# Altium schematic sheet ReconProbe.SchDoc (part 2 of 2)
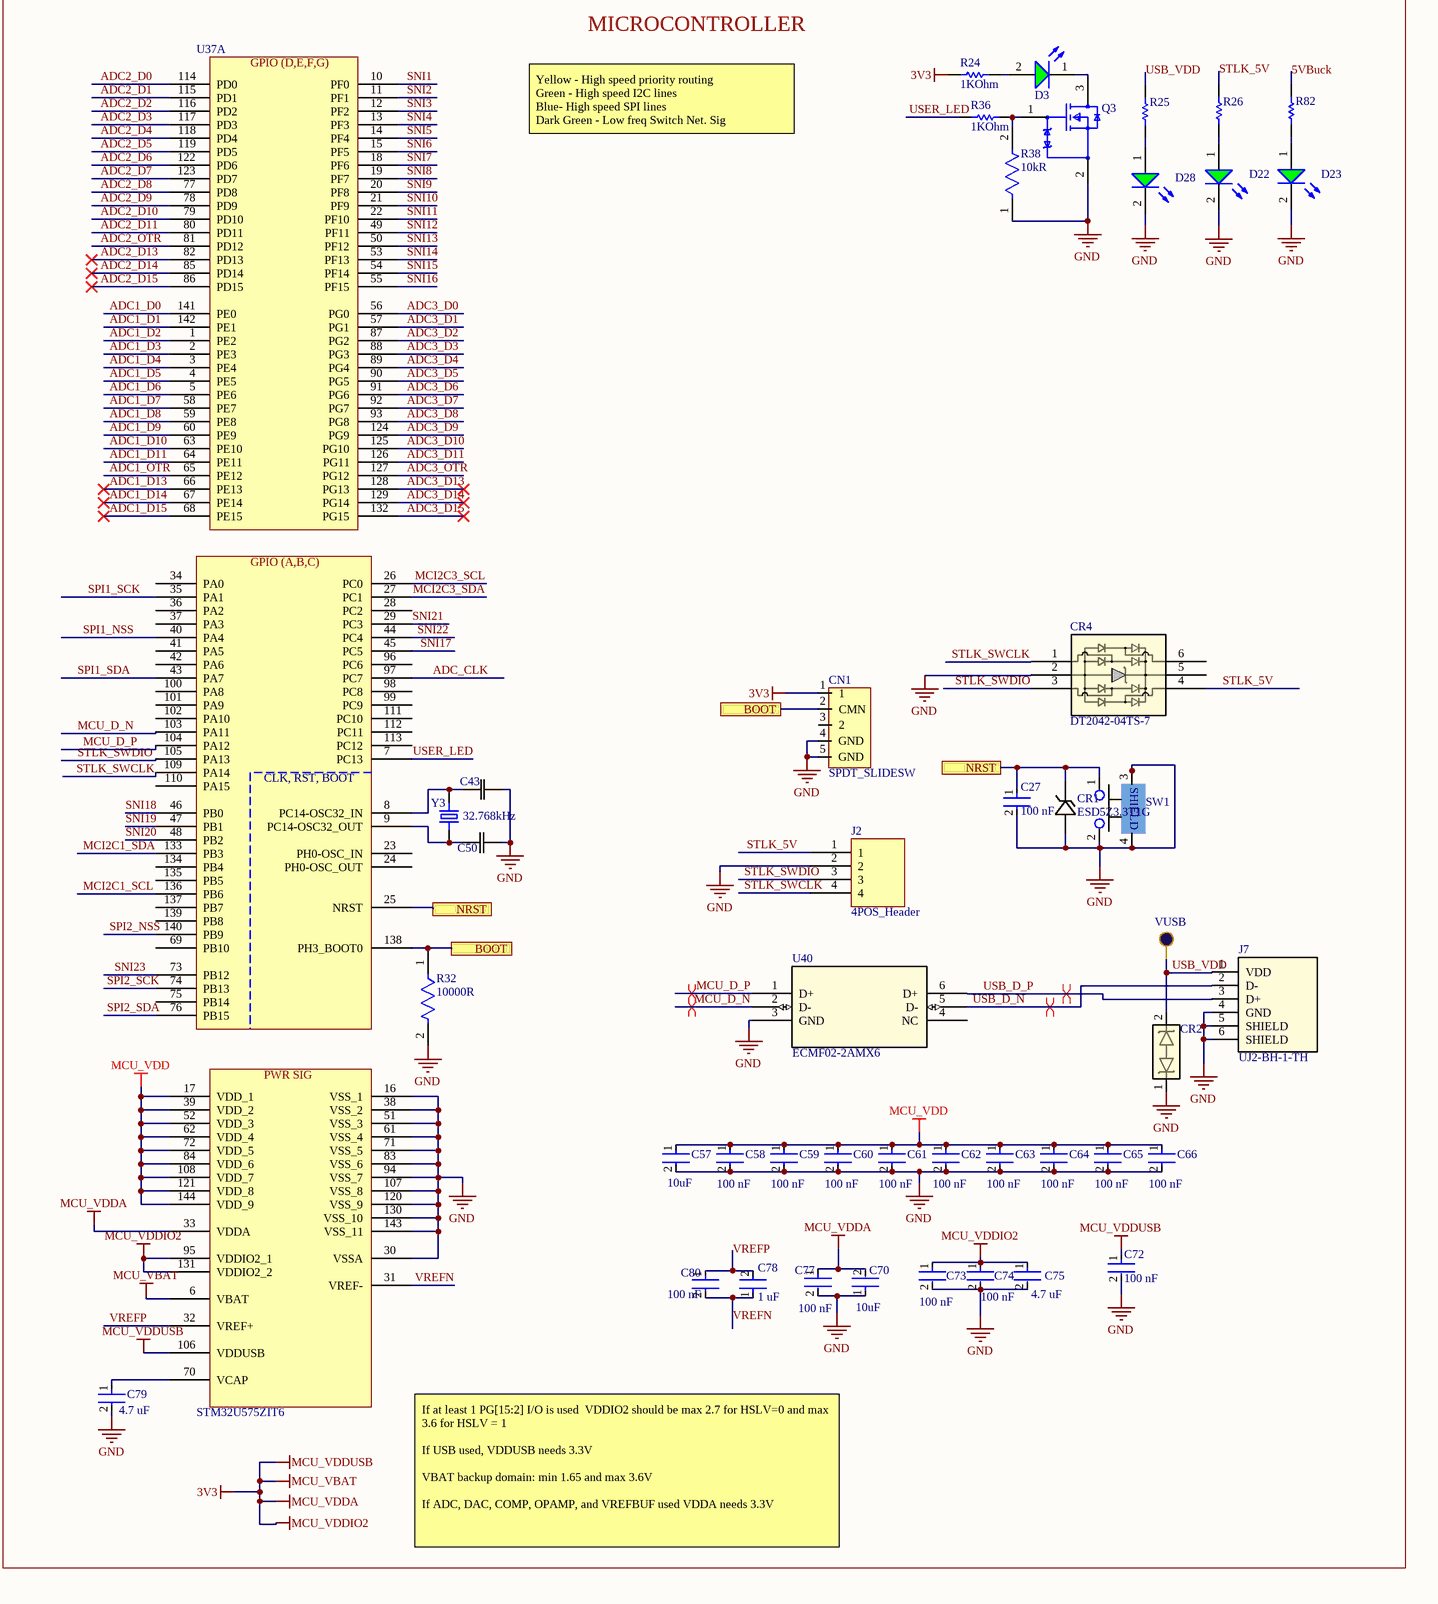
[diagram p6: ReconProbe.SchDoc, bottom right]

## Library data of the parts
0V5 3V0 3V3 VUSB = TestPoint_1.10mm
AD1 AD2 = CMP-0293-00077-1: Low Power, 12.65 mW, 2.3 V to 5.5 V, Programmable Waveform Generator, 10-Bit, Serial, RM-10, 50 Tube, Pb-Free; Resolution (Bits): 10bit; Compliance Range (V): 650mV; FS Iout (mA nom): 3mA; REFCLK Multiplier: No; Master fclk: 25MHz; I Supply total (max): 5.5mA; Tuning Word Width (bits): 28bit; Code_JEDEC: MO-187-BA; DatasheetVersion: Rev. D; PackageVersion: 5/8/2005; ComponentLink1URL: www.analog.com; ComponentLink3Description: Package Specification; PackageDescription: 10-Lead Mini Small Outline Package [MSOP]; I/O Interface: Serial; ComponentLink2Description: Datasheet; ComponentLink1Description: Manufacturer URL; PackageReference: RM-10; ComponentLink2URL: http://www.analog.com/static/imported-files/data_sheets/AD9833.pdf; ComponentLink3URL: http://www.analog.com/static/imported-files/packages/PKG_PDF/MSOP%28RM%29/RM_10.pdf
C1 C2 C13 C69 C71 C78 C88 C89 C93 C96 C97 C122-C125 C142 C146 C147 = CMP-03422-000001-1: CAP CER 1UF 16V X7R 0805; Manufacturer: Yageo; Material: Ceramic; Tolerance: 0.1; Voltage Rating: 16 V; Category: Cap; ComponentLink2Description: Datasheet; Automotive: No; Temperature Range High: +85°C; RoHS: TRUE; Footprint Url: http://www.yageo.com/exep/pages/download/literatures/UPY-C_GEN_24.pdf; Mouser Description: Multilayer Ceramic Capacitors MLCC - SMD/SMT 1.0uF 16V X7R 10%; Height: 0.95mm; Ipc Land Pattern Name: CAPC200125X85; Temperature: -30°C to +85°C; Lead Free: Yes; Value: 1 uF; Temperature Characteristic: X7R; Package: CC0805-0.85; Temperature Range Low: -30°C; Device Class L1: Passive Components; Device Class L3: Ceramic Capacitors; Octopart: https://octopart.com/cc0805kkx7r7bb105-yageo-8376555; Manufacturer Part Number: CC0805KKX7R7BB105; ComponentLink2URL: http://www.yageo.com/documents/recent/UPY-GPHC_Y5V_6.3V-to-50V_8.pdf; Device Class L2: Capacitors; Digikey Description: CAP CER 1UF 16V X7R 0805
C3 C9 C10 C12 C14 C19-C21 C23 C24 C26 C29 C30 C32 C33 C40 = CMP-2008-02108-2: CAP CER 0.1UF 16V X7R 0402; Manufacturer: Kemet; Value: 100nF; Tolerance: 0.1; Material: Ceramic; Temperature Coefficient: 15%; Voltage Rating: 16 V; Package: C0402-BB; Automotive: No; Ipc Land Pattern Name: CAPC10050X50; Device Class L3: Ceramic Capacitors; Octopart: https://octopart.com/c0402c104k4ractu-kemet-94158; Temperature Characteristic: X7R; Mouser Description: Cap Ceramic 0.1uF 16V X7R 10% SMD 0402 125?C Paper T/R - Tape and Reel (Alt: C0402C104K4RAC TU); ComponentLink2Description: Datasheet; Temperature Range Low: -55°C; RoHS: TRUE; Device Class L1: Passive Components; Manufacturer Part Number: C0402C104K4RACTU; Temperature Range High: +125°C; Device Class L2: Capacitors; ComponentLink2URL: https://content.kemet.com/datasheets/KEM_C1002_X7R_SMD.pdf; Category: Cap; Height: 0.55mm; Temperature: -55°C to +125°C; Lead Free: Yes; Digikey Description: CAP CER 0.1UF 16V X7R 0402
C4 C5 C8 C11 C17 C18 C22 C25 C31 C34 C35 C37 C42 C46 C47 C52 C56 C57 C67 C70 C81 C85 C94 C128 C130 C133 C135 C138 = CMP-03422-001507-1: CAP CER 10UF 10V X5R 0603; Tolerance: 10%; Case/Package: 0603; Length: 0.063inch; Dielectric: X5R; Mount: Surface Mount; Case Code (Metric): 1608; Depth: 0.8mm; Voltage Rating (DC): 10V; Voltage Rating: 10V; Lead Free: Lead Free; Resistor Type: Ceramic; Packaging: Tape and Reel; Max Operating Temperature: 85°C; Termination: SMD/SMT; Min Operating Temperature: -55°C; Weight: 7.1E-05oz; Thickness: 0.035inch; Case Code (Imperial): 0603; Package Quantity: 4000; Halogen Free: Halogen Free; RoHS Compliant: Yes; Width: 0.031inch
  C5: Capacitance: 10uF
C6 C7 C15 C16 = CMP-2008-03773-2: Multi-Layer Ceramic Capacitor 3pF C0G  ±0.05pF 0402 Paper T/R; Voltage Rating: 50V; Case Code (Imperial): 0402; Radiation Hardening: No; Max Operating Temperature: 125°C; Case/Package: 0402; Length: 1mm; Depth: 0.5mm; Min Operating Temperature: -55°C; Mount: Surface Mount; Dielectric: C0G; Thickness: 0.022inch; Width: 0.5mm; Voltage Rating (DC): 50V; Case Code (Metric): 1005; Height: 0.5mm; Packaging: Tape and Reel; Termination: SMD/SMT; Package Quantity: 10000
C27 C28 C55 C58-C66 C68 C72-C74 C76 C77 C80 C95 C98 C118 = CMP-03422-000048-1: CAP CER 0.1UF 16V X7R 0402; Manufacturer: YAGEO; Material: Ceramic; Automotive Grade: NA; Temperature Coefficient: 30ppm/°C; Tolerance: 0.1; Value: 100 nF; Device Class L1: Passive Components; Temperature Range Low: -55°C; Device Class L3: Ceramic Capacitors; Temperature Characteristic: X7R; Ipc Land Pattern Name: CAPC10050X50; Temperature Range High: +125°C; Voltage Rating: 16 V; Temperature: -55°C to +125°C; RoHS: TRUE; Automotive: No; Height: 0.55mm; Device Class L2: Capacitors; Digikey Description: CAP CER 0.1UF 16V X7R 0402; Package: CC0402; Footprint Url: http://www.yageo.com/exep/pages/download/literatures/UPY-C_GEN_24.pdf; ComponentLink2Description: Datasheet; Category: Cap; Lead Free: Yes; Octopart: https://octopart.com/cc0402krx7r7bb104-yageo-42244624; ComponentLink2URL: http://www.yageo.com/documents/recent/UPY-GP_NP0_16V-to-50V_16.pdf; Manufacturer Part Number: CC0402KRX7R7BB104; Mouser Description: 0402 0.1 uF 16 V ±10 % Tolerance X7R SMT Multilayer Ceramic Capacitor
C36 C38 C39 C41 C44 C45 C48 C51 C126 C127 C129 C131 C132 C134 C136 C137 = CMP-2008-02108-2: CAP CER 0.1UF 16V X7R 0402; Manufacturer: Kemet; Value: 0.10 μF; Tolerance: 0.1; Material: Ceramic; Temperature Coefficient: 15%; Voltage Rating: 16 V; Package: C0402-BB; Automotive: No; Ipc Land Pattern Name: CAPC10050X50; Device Class L3: Ceramic Capacitors; Octopart: https://octopart.com/c0402c104k4ractu-kemet-94158; Temperature Characteristic: X7R; Mouser Description: Cap Ceramic 0.1uF 16V X7R 10% SMD 0402 125?C Paper T/R - Tape and Reel (Alt: C0402C104K4RAC TU); ComponentLink2Description: Datasheet; Temperature Range Low: -55°C; RoHS: TRUE; Device Class L1: Passive Components; Manufacturer Part Number: C0402C104K4RACTU; Temperature Range High: +125°C; Device Class L2: Capacitors; ComponentLink2URL: https://content.kemet.com/datasheets/KEM_C1002_X7R_SMD.pdf; Category: Cap; Height: 0.55mm; Temperature: -55°C to +125°C; Lead Free: Yes; Digikey Description: CAP CER 0.1UF 16V X7R 0402
C43 C50 = CC0805CRNPO9BN4R0: No Description Available; Mfr_Name: Yageo
C49 C53 C54 C139 C140 = CMP-2008-04254-2: Chip Multilayer Ceramic Capacitors for General Purpose, 0402, 1000pF, C0G, 30ppm/°C, 5%, 50V; Insulation Resistance: 10GR; Packaging: Tape and Reel; Lead Free: Lead Free; Tolerance: 5%; Temperature Coefficient: 30ppm/°C; Thickness: 0.022inch; Termination: SMD/SMT; Max Operating Temperature: 125°C; Height: 0.5mm; Package Quantity: 1; Radiation Hardening: No; Material: Ceramic; Case Code (Metric): 1005; Number of Pins: 2; Voltage Rating: 50V; Mount: Surface Mount; Voltage: 50V; Case/Package: 0402; Min Operating Temperature: -55°C; Dielectric Material: Ceramic; Width: 0.5mm; Depth: 0.5mm; Case Code (Imperial): 0402; REACH SVHC: No SVHC; Dielectric: C0G; Voltage Rating (DC): 50V; Length: 1mm
C75 C79 = CMP-03422-001236-1: CAP CER 4.7UF 16V X5R 0603; Manufacturer: YAGEO; Temperature Coefficient: 15%; Material: Ceramic; Tolerance: 0.1; Temperature Characteristic: X5R; Footprint Url: http://www.yageo.com/exep/pages/download/literatures/UPY-C_GEN_24.pdf; ComponentLink2URL: http://www.yageo.com/documents/recent/UPY-GPHC_X7R_6.3V-to-50V_18.pdf; ComponentLink2Description: Datasheet; Device Class L3: Ceramic Capacitors; Category: Cap; Voltage Rating: 16 V; Automotive: No; Temperature Range High: +125°C; Value: 4.7 uF; Device Class L1: Passive Components; RoHS: TRUE; Manufacturer Part Number: CC0603KRX5R7BB475; Device Class L2: Capacitors; Voltage: 16 V; Height: 0.9mm; Temperature Range Low: -55°C; Temperature: -55°C to +125°C; Mouser Description: Multilayer Ceramic Capacitors MLCC - SMD/SMT 4.7uF 16V X5R 10%; Octopart: https://octopart.com/cc0603krx5r7bb475-yageo-34978295; Package: CC0603-DA; Lead Free: Yes; Digikey Description: CAP CER 4.7UF 16V X5R 0603
C82 C83 = RHA1C151MCN1GS: No Description Available; Mfr_Name: Nichicon
C84 C99-C117 C119 C141 C143 = CMP-13271-001433-1: CL21 Series 0805 1uF 50V ±10% Tolerance X7R Multilayer Ceramic Chip Capacitor; Case Code (Metric): 2012; Max Operating Temperature: 125°C; Termination: Wraparound; Voltage: 50V; Min Operating Temperature: -55°C; Packaging: Tape and Reel; Contact Plating: Tin; Case/Package: 0805; Depth: 1.25mm; Case Code (Imperial): 0805; Mount: Surface Mount; Material: Ceramic; Tolerance: 10%; Thickness: 0.053inch; Package Quantity: 3000; Voltage Rating: 50V; Width: 0.049inch; Length: 2mm; Dielectric: X7R
C86 = CMP-2006-02467-2: Chip Multilayer Ceramic Capacitors for General Purpose, 0603, 3300pF, C0G, 30ppm/°C, 5%, 50V; Max Operating Temperature: 125°C; Voltage Rating (DC): 50V; Termination: SMD/SMT; Packaging: Tape and Reel; Tolerance: 5%; Lead Free: Lead Free; Width: 0.031inch; Thickness: 0.035inch; REACH SVHC: No SVHC; Dielectric: C0G; Min Operating Temperature: -55°C; Material: Ceramic; Voltage Rating: 50V; Case/Package: 0603; Length: 1.6mm; Voltage: 50V; Case Code (Imperial): 0603; Radiation Hardening: No; Case Code (Metric): 1608; Mount: Surface Mount; Height: 0.8mm; Package Quantity: 4000; Depth: 0.8mm
C87 = CMP-13271-003225-1: CL21 Series 0805 22uF 25V ±20% Tolerance X5R Multilayer Ceramic Chip Capacitor
C90 C92 = CMP-08246-006241-1: Multilayer Ceramic Capacitors 2.2μF ±10% 16V X7R SMD 0805; Radiation Hardening: No; Series: C; REACH SVHC: No SVHC; Max Operating Temperature: 125°C; Case Code (Metric): 2012; Construction: Flat; Lead Free: Lead Free; Number of Pins: 2; Voltage Rating: 16V; Min Operating Temperature: -55°C; Voltage Rating (DC): 16V; Package Quantity: 2000; Thickness: 0.057inch; Case Code (Imperial): 0805; RoHS Compliant: Yes; Length: 2mm; Depth: 1.25mm; Packaging: Tape and Reel; Tolerance: 10%; Mount: Surface Mount; Dielectric: X7R; Width: 1.25mm; Case/Package: 0805; Weight: 0.000194oz; Dielectric Material: Ceramic; Termination: SMD/SMT; Voltage: 16V; Resistor Type: Ceramic; Height: 1.25mm
C91 = CMP-2007-01079-2: CAP CER 10000PF 50V X7R 0805; Manufacturer: KEMET; Material: Ceramic; Tolerance: 0.1; Value: 10,000 pF; Temperature Coefficient: 30ppm/°C; Temperature: -55°C to +125°C; Device Class L3: Ceramic Capacitors; ComponentLink2URL: https://content.kemet.com/datasheets/KEM_C1003_C0G_SMD.pdf; Temperature Range Low: -55°C; Manufacturer Part Number: C0805C103K5RACTU; Ipc Land Pattern Name: CAPC200125X78; Height: 0.88mm; Temperature Range High: +125°C; Category: Cap; ComponentLink2Description: Datasheet; Octopart: https://octopart.com/c0805c103k5ractu-kemet-90536; Package: C0805C-DN; Device Class L2: Capacitors; Voltage Rating: 50 V; RoHS: TRUE; Automotive: No; Digikey Description: CAP CER 10000PF 50V X7R 0805; Temperature Characteristic: X7R; Device Class L1: Passive Components; Lead Free: Yes
C120 C121 = CMP-2008-03796-2: Multi-Layer Ceramic Capacitor 10pF C0G  ±2% 0402 Paper T/R; Voltage Rating: 50V; Thickness: 0.022inch; Case Code (Imperial): 0402; Height: 0.5mm; Min Operating Temperature: -55°C; Lead Free: Lead Free; Case Code (Metric): 1005; Mount: Surface Mount; Voltage Rating (DC): 50V; Width: 0.5mm; Max Operating Temperature: 125°C; Case/Package: 0402; Packaging: Tape and Reel; Depth: 0.5mm; Package Quantity: 1; Termination: SMD/SMT; Length: 1mm; Dielectric: C0G; Tolerance: 2%; Radiation Hardening: No
C144 C145 = CMP-2100-03600-2: CAP CER 10000PF 50V X7R 0603; Manufacturer: YAGEO; Tolerance: 0.1; Material: Ceramic; Temperature Coefficient: 15%; Value: 10 nF; Mouser Description: Multilayer Ceramic Capacitor, CC Series, 0.01 - F, - 10%, X7R, 50 V, 0603 [1608 Metric]; Digikey Description: CAP CER 10000PF 50V X7R 0603; Height: 0.9mm; Category: Cap; Temperature Characteristic: X7R; Footprint Url: http://www.yageo.com/exep/pages/download/literatures/UPY-C_GEN_24.pdf; Lead Free: Yes; Voltage Rating: 50 V; Manufacturer Part Number: CC0603KRX7R9BB103; Temperature: -55°C to +125°C; Device Class L3: Ceramic Capacitors; ComponentLink2Description: Datasheet; Voltage: 50 V; Package: CC0603-DA; Octopart: https://octopart.com/cc0603krx7r9bb103-yageo-192938; Automotive: No; Temperature Range High: +125°C; Temperature Range Low: -55°C; RoHS: TRUE; Device Class L1: Passive Components; ComponentLink2URL: http://www.yageo.com/documents/recent/UPY-GPHC_X7R_6.3V-to-50V_18.pdf; Device Class L2: Capacitors
CR1 = ESD5Z3.3T1G: TVS 3.3V, 5VBRK, SOD532; Mfr_Name: onsemi; RefDes: RefDes; Type: Type
CR2 = DESD5V0U1BA-7: TVS-Bidirectional-5V,5.5VBRK; Mfr_Name: Diodes Inc; RefDes: RefDes; Type: Type
CR4 = DT2042-04TS-7: No Description Available; Mfr_Name: Diodes Inc; RefDes: RefDes; Type: Type
D1 D2 D4-D21 D24-D26 = CMP-2000-04932-2: Fast Switching Diode, 100 V, 0.15 A, -65 to 150 degC, 2-Pin?SOD123, RoHS, Tape and Reel; Recovery Time: 4ns; Brand: DiodesIncorporated; Unit Weight: 0.000353oz; Max Surge Current: 2A; Peak Reverse Voltage: 100V; Ir - Reverse Current: 1uA; Vf - Forward Voltage: 1.25V; Configuration: Single; If - Forward Current: 0.15A; Product Category: Diodes-GeneralPurpose,Power,Switching; Operating Temperature Range: -65Cto+150C; Packaging: Reel; Manufacturer URL: http://www.diodes.com/; Maximum Operating Temperature: +150C; Height: 1.25mm; Minimum Operating Temperature: -65C; Product: SwitchingDiodes; Package URL: http://www.diodes.com/datasheets/ds18004.pdf; Type: SwitchingDiode; Package Reference: SOD123-2; Width: 1.7mm; Datasheet URL: http://www.farnell.com/datasheets/1915529.pdf; Datasheet Version: Rev. 24-2, 10/2013; Series: 1N4148; Factory Pack Quantity: 3000; Length: 2.85mm; RoHS: True; Manufacturer: DiodesIncorporated; Mounting Style: SMD/SMT; Package / Case: SOD-123
D3 = 156120VS82500P: WL-SMRW Mono-color Reverse mount Waterclear, SMT, size 1206 dome, Bright Green, 2V, 20°; Manufacturer: Wurth Elektronik; Chip Technology: AlInGaP; Dominant Wavelength: 573nm; Luminous Intensity: 1050mcd; Peak Wavelength: 575nm; Manufacturer Part Number: 156120VS82500P; Category: Signal LEDs; Match Code: WL-SMRW; ComponentLink1Description: Website Link; ComponentLink1URL: https://www.we-online.com/redexpert/article/156120VS82500P?ad; ComponentLink2Description: Datasheet Link; ComponentLink2URL: https://www.we-online.com/redexpert/spec/156120VS82500P?ad; Mount: Surface Mount; Operating Temperature Max: 85°C; Operating Temperature Min: -40°C; Packaging: Tape and Reel; Case/Size Code: 1206 dome; Length: 3.2mm; Width: 1.6mm; Height: 1.85mm; Emitting Color: Bright Green; Forward Voltage: 2V; Viewing Angle: 20°
D22 D23 D28 = CMP-1488-00004-2: NexarPartId: 29717805; Peak Wavelength: 560nm; Lens Style: Circular, Diffused, Round; Forward Voltage: 2.2V; Lens Size: 3mm; Wavelength: 568nm; Test Current: 20mA; Max Reverse Voltage (DC): 5V; Color: Green; Forward Current: 100mA; Viewing Angle: 60°; Luminous Intensity: 30mcd; Case/Package: Radial; RoHS: Compliant; Packaging: Bulk; Max Operating Temperature: 85°C; Lead Free: Lead Free; Min Operating Temperature: -40°C; Length: 3mm; Width: 3mm; REACH SVHC: Unknown; Mount: Through Hole; Height: 5.3mm; Dominant Wavelength: 568nm
D27 = CMP-2000-06604-2: DIODE SCHOTTKY 15V 1A DO214BA; Manufacturer: Microsemi; Capacitance: 150pF; Peak Reverse Current: 10mA; Value: 150pF; Max Junction Temp: +100°C; Standoff Height: 0.01mm; Max Surge Forward Current: 50A; Device Class L2: Diodes; Automotive: No; Forward Current: 1A; ComponentLink2URL: https://media.digikey.com/pdf/Data%20Sheets/Microsemi%20PDFs/LSM115J.pdf; Max Repetitive Reverse Voltage: 15V; Mouser Description: Schottky Diodes & Rectifiers Schottky Rectifier; Device Class L3: Rectifier Diodes; Footprint Url: https://www.microsemi.com/packaging-information/partpackage/details?pid=5147; Octopart: https://octopart.com/lsm115je3%2Ftr13-microsemi-17743343; Category: Diode; Height: 2.92mm; RoHS: TRUE; Device Class L1: Discrete Semiconductors; Manufacturer Part Number: LSM115JE3/TR13; Lead Free: Yes; Temperature Range High: +100°C; ComponentLink2Description: Datasheet; Package: DO-214BA; Digikey Description: DIODE SCHOTTKY 15V 1A DO214BA; Temperature Range Low: -55°C; Temperature: -55°C to +100°C; Reverse Voltage: 15V
J2 = 4POS_Header: 90deg THT
J7 = UJ2-BH-1-TH: No Description Available; Mfr_Name: Same Sky; RefDes: RefDes; Type: Type
J10 = PJ-002B: 2.5 x 6.5 mm, 2.5 A, Horizontal, Through Hole, Dc Power Jack Connector; MF: CUI Devices; SnapEDA_Link: https://www.snapeda.com/parts/PJ-002B/CUI+Devices/view-part/?ref=snap; Package: None; MP: PJ-002B; CUI_purchase_URL: https://www.cuidevices.com/product/interconnect/connectors/dc-power-connectors/jacks/pj-002b?utm_source=snapeda.com&utm_medium=referral&utm_campaign=snapedaBOM; Check_prices: https://www.snapeda.com/parts/PJ-002B/CUI+Devices/view-part/?ref=eda; Purchase-URL: https://pricing.snapeda.com/search/part/PJ-002B/?ref=eda; Price: None; Value: *; Availability: In Stock
K4-K21 K23 = J1031C5VDC.15S
L1 = CMP-06042-014522-1: Shielded Wirewound Inductor 2.2uH 20% 2200mA 0.084Ω 1008 (2520); Max DC Current: 2.2A; Current Rating: 3A; Core Material: Ferrite; Test Frequency: 1MHz; DC Resistance (DCR): 84mR; Case/Package: 1008; Case Code (Metric): 2520; Resistor Type: Wirewound; Lead Free: Lead Free; Shielding: Shielded; Depth: 2mm; Case Code (Imperial): 1008; Packaging: Tape and Reel; Width: 0.079inch; Min Operating Temperature: -40°C; Height - Seated (Max): 0.039inch; Tolerance: 20%; Max Operating Temperature: 125°C; Mount: Surface Mount; Length: 0.098inch
Q1-Q5 Q10-Q26 Q28 Q29 = CMP-1058-00766-2: MOSFET N-CH 60V 320MA SOT-23; Max Power Dissipation: 420mW; Nominal Vgs: 2.3V; Fall Time: 9ns; Turn-Off Delay Time: 55.8ns; Number of Elements: 1; Rds On Max: 1.6R; Input Capacitance: 24.5pF; Turn-On Delay Time: 12.2ns; Element Configuration: Single; Gate to Source Voltage (Vgs): 20V; Power Dissipation: 300mW; Width: 1.4mm; Halogen Free: Halogen Free; Packaging: Tape and Reel; Radiation Hardening: No; Rise Time: 9ns; Case/Package: SOT-23-3; Number of Pins: 3; Min Operating Temperature: -55°C; REACH SVHC: No SVHC; Max Operating Temperature: 150°C; Height: 1.01mm; Length: 3.04mm; Contact Plating: Tin; Continuous Drain Current (ID): 320mA; Drain to Source Breakdown Voltage: 60V; Lead Free: Lead Free; Drain to Source Resistance: 1.6R; Threshold Voltage: 2.3V; Package Quantity: 1; On-State Resistance: 1.6R
Q6-Q9 Q27 = CMP-1693-00002-4: MOSFET P-CH 20V 4.2A SOT23; Turn-On Delay Time: 10.8ns; Turn-Off Delay Time: 79.3ns; Threshold Voltage: -900mV; Rise Time: 13.7ns; Gate to Source Voltage (Vgs): 8V; Rds On Max: 52mR; Element Configuration: Single; Fall Time: 34.7ns; Max Power Dissipation: 1.4W; Drain to Source Resistance: 200mR; Number of Channels: 1; Input Capacitance: 808pF; Lead Free: Lead Free; Number of Pins: 3; Length: 3mm; Continuous Drain Current (ID): 4.2A; Contact Plating: Tin; Mount: Surface Mount; Weight: 0.000282oz; Min Operating Temperature: -55°C; Package Quantity: 3000; Drain to Source Voltage (Vdss): 20V; On-State Resistance: 52MR; Max Operating Temperature: 150°C; Height: 1.1mm; REACH SVHC: No SVHC; Packaging: Tape and Reel; Radiation Hardening: No; Case/Package: SOT-23; Width: 1.4mm
R1 R2 = CMP-26527-004035-1: 200kΩ ±1% 0.125W 0805 Thick Film Chip Resistor AEC-Q200 compliant; Max Power Dissipation: 125mW; Temperature Coefficient: 100ppm/°C; Working Voltage: 150V; Technology: THICK FILM; Max Operating Temperature: 155°C; Min Operating Temperature: -55°C; Case/Package: 0805; Width: 0.049inch; Case Code (Imperial): 0805; Resistor Type: Thick Film; Case Code (Metric): 2012; Packaging: Tape and Reel; Contact Plating: Tin; Lead Free: Lead Free; Number of Terminations: 2; Radiation Hardening: No; Length: 2mm; Height: 0.026inch; Depth: 1.25mm; Construction: Rectangular; RoHS Compliant: Yes; Power Rating: 125mW; Military Standard: Not; Mount: Surface Mount; Features: Automotive AEC-Q200; Series: RMCF; Tolerance: 1%
R3-R6 = CMP-2100-03615-2: RES Thick Film, 4.7kΩ, 1%, 0.125W, 100ppm/°C, 0805; Max Power Dissipation: 125mW; Voltage Rating: 150V; Termination: SMD/SMT; Weight: 0.000194oz; Case/Package: 0805; Number of Terminations: 2; Min Operating Temperature: -55°C; Case Code (Metric): 2012; Package Quantity: 10; Depth: 1.25mm; Military Standard: Not; Composition: Thick Film; Radiation Hardening: No; Contact Plating: Tin; Height: 0.45mm; Power Rating: 125mW; Features: Automotive AEC-Q200; Tolerance: 1%; Packaging: Tape and Reel; Max Operating Temperature: 155°C; Length: 2mm; Case Code (Imperial): 0805; Voltage Rating (DC): 150V; Width: 1.25mm; Temperature Coefficient: 100ppm/°C; Lead Free: Lead Free
R7 R9 R16 R18 R20-R22 R24 R28 R30 R33-R36 R63 R67 R74-R76 R81 = CMP-2100-03671-1: Chip Resistor, 1 KOhm, +/- 1%, 125 mW, -55 to 155 degC, 0805 (2012 Metric), RoHS, Tape and Reel; Manufacturer: Yageo; Temperature Coefficient: 100ppm/degreesC; Voltage Rating (DC): 150V; Max Power Dissipation: 125mW; Number of Pins: 2; Number of Terminations: 2; Datasheet URL: http://www.yageo.com/NewPortal/yageodocoutput?fileName=/pdf/R-Chip/PYu-RC_Group_51_RoHS_L_5.pdf; Length: 0.079inch; Package Description: 2-Pin Surface Mounted Device, Body 2 x 1.25 mm; Depth: 1.25mm; Height: 0.024inch; Military Standard: Not; Case/Package: 0805; Package Reference: 0805; RoHSCompliant: true; Lead Free: LeadFree; Packaging: TapeandReel; Package Quantity: 1; Datasheet Version: Rev. 5, 10/2016; Tolerance: 1%; Min Operating Temperature: -55degC; Voltage Rating: 150V; Composition: ThickFilm; Case Code (Imperial): 0805; Power Rating: 125mW; Width: 0.049inch; Case Code (Metric): 2012; Manufacturer URL: http://www.yageo.com/; Max Operating Temperature: 155degC; REACH SVHC: Unknown; Termination: SMD/SMT
R8 R15 = CMP-2001-01222-1: Manufacturer: Yageo; Part Number: RC0805FR-07604RL
R10 R12-R14 R17 R19 R38-R40 R42-R59 R64 R65 R73 = CMP-26527-000121-1: RES 10K OHM 1% 1/8W 0805; Power Rating: 125mW; Temperature Coefficient: 100ppm/°C; Depth: 1.25mm; Construction: Rectangular; Packaging: Tape and Reel; Tolerance: 1%; Lead Free: Lead Free; Case/Package: 0805; RoHS Compliant: Yes; Series: RMCF; Width: 0.049inch; Max Power Dissipation: 125mW; Contact Plating: Tin; Height: 0.026inch; Mount: Surface Mount; Resistor Type: Thick Film; Size Code: 0805; Length: 2mm; Max Operating Temperature: 155°C; Features: Automotive AEC-Q200; Radiation Hardening: No; Case Code (Imperial): 0805; Min Operating Temperature: -55°C; Case Code (Metric): 2012; Number of Terminations: 2; Military Standard: Not
R11 = CMP-2000-06989-2: 100kΩ ±1% 0.1W 0603 Thick Film Chip Resistor AEC-Q200 compliant; Working Voltage: 75V; Max Power Dissipation: 100mW; Resistance: 100kR; Temperature Coefficient: 100ppm/°C; Height: 0.022inch; Construction: Rectangular; Lead Free: Lead Free; Tolerance: 1%; Features: Automotive AEC-Q200; Packaging: Tape and Reel; Number of Terminations: 2; Mount: Surface Mount; Case Code (Imperial): 0603; Case/Package: 0603; Resistor Type: Thick Film; Radiation Hardening: No; Power Rating: 100mW; Max Operating Temperature: 155°C; Length: 1.55mm; Width: 0.031inch; Military Standard: Not; RoHS Compliant: Yes; Min Operating Temperature: -55°C; Series: RMCF; Depth: 0.8mm; Case Code (Metric): 1608; Contact Plating: Tin
R23 R31 R41 = CMP-2001-01390-1: 5.1k; Manufacturer: Yageo; Part Number: RC0805JR-075K1L
R25 R26 R82 = CMP-2001-00609-1: Manufacturer: Panasonic; Part Number: ERA6AEB202V
R27 R29 R62 = CRCW08054K00FKTA: 4 kOhms Â±1% 0.125W, 1/8W Chip Resistor 0805 _2012 Metric_ Automotive AEC-Q200 Thick Film; MF: Vishay Dale; SnapEDA_Link: https://www.snapeda.com/parts/CRCW08054K00FKTA/Vishay%20Dale/view-part/982681/?ref=snap; MP: CRCW08054K00FKTA; Value: *; Price: None; Package: 2012 Vishay; Availability: Unavailable
R32 = CMP-02407-011560-1: RES 10K OHM 1% 1/8W 0805; Power Rating: 125mW; RoHS Compliant: Yes; Case/Package: 0805; Tolerance: 1%; Lead Free: Lead Free
R37 = CMP-00621-116361192-1: RT0402FRE07500RL Resistor Thin Film 0402 500 Ohm ±1% 1/16W ±50ppm/°C Molded Paper T/R; Voltage Rating: 50V; Resistance: 500Ω; Power Rating: 63mW; Temperature Coefficient: 50ppm/°C; Tolerance: 1%; Max Operating Temperature: 155°C; Min Operating Temperature: -55°C; NexarPartId: 116361192; Case/Package: 0402; Composition: Thin Film; Height: 350µm; Packaging: Tape & Reel
R60 R61 R68 = CMP-2001-00580-1: Manufacturer: Panasonic; Part Number: ERA6AEB101V
R66 = RT0603BRE0750RL: 50 Ohms Â±0.1% 0.1W, 1/10W Chip Resistor 0603 (1608 Metric) Thin Film; MF: Yageo; MP: RT0603BRE0750RL; SnapEDA_Link: https://www.snapeda.com/parts/RT0603BRE0750RL/Yageo/view-part/1011371/?ref=snap; Mouser-Purchase-URL: https://snapeda.com/shop?store=Mouser&id=1011371; Price: None; Availability: Warning; Package: 1608 Yageo; Value: *; BuyPart: https://www.snapeda.com/parts/RT0603BRE0750RL/Yageo/view-part/1011371/?ref=eda
R69-R72 = CMP-1665-00002-5: Chip Resistor, 0 Ohm, +/- 1%, 0.125 W, -55 to 155 degC, 0805 (2012 Metric), RoHS, Tape and Reel; Tolerance: 5%; REACH SVHC: No SVHC; Min Operating Temperature: -55 degC; Case/Package: 0805; Packaging: Tape and Reel; Package Quantity: 5000; ComponentLink1Description: Manufacturer URL; PackageDescription: 2-Pin Surface Mount Device, Body 2 x 1.25 mm; Mounting Technology: Surface Mount; Max Operating Temperature: 155 degC; PartNumber: ERJ-6GEY0R00V; Width: 1.25 mm; RoHSCompliant: True; Height: 0.6 mm; ComponentLink1URL: http://www.panasonic.com/; ComponentLink2URL: http://industrial.panasonic.com/cdbs/www-data/pdf/RDA0000/AOA0000C84.pdf; Case Code (Imperial): 0805; DatasheetVersion: 03/2015; Length: 2 mm; Case Code (Metric): 2012; ComponentLink2Description: Datasheet; Radiation Hardening: No
S1 = L102021ML04Q: Slide Switch SPDT Through Hole, Right Angle; MF: C&K; SnapEDA_Link: https://www.snapeda.com/parts/L102021ML04Q/C%2526K/view-part/?ref=snap; Package: None; MP: L102021ML04Q; Check_prices: https://www.snapeda.com/parts/L102021ML04Q/C%2526K/view-part/?ref=eda; Purchase-URL: https://pricing.snapeda.com/search/part/L102021ML04Q/?ref=eda; Price: None; Value: *; Availability: In Stock
SW1 = TAC_PB_TL6110DF160QP: https://www.digikey.ca/en/products/detail/e-switch/TL6110DF160QP/1137150
U3 U23 = MCP4531-104EMS: Mfr_Name: Microchip; RefDes: RefDes; Type: Type
U4 U28 = MCP4531T-103EMS: No Description Available; Mfr_Name: Microchip; RefDes: RefDes; Type: Type
U5 U6 = NVT2002DP,118: No Description Available; Mfr_Name: NXP; RefDes: RefDes; Type: Type
U8 U38 U39 = AD9235BRUZ-40: No Description Available; Mfr_Name: Analog Devices Inc; RefDes: RefDes; Type: Type
U9 U30 = OPA2356AIDR: No Description Available; Mfr_Name: Texas Instruments; RefDes: RefDes; Type: Type
U15 U16 U21 U25 U29 U36 = SN74LVC1T45DBVR: No Description Available; Mfr_Name: Texas Instruments; Alternate_PartNumber: SN74LVC1T45DBVT; CompType: IC; TYPE: TYPE; RefDes: RefDes; Application_BuildNumber: *; PartNumber: SN74LVC1T45DBVR; PackageReference: DBV0006A; MountType: SMT; RoHS: Y; Manufacturer: Texas Instruments
U31 U52 = CMP-09083-000040-1: IC DGTL POT 100KOHM 256TAP SOT23; Resistance: 100kR; Max Supply Current: 3uA; Resistance Tolerance: 30%; Max Supply Voltage: 5.5V; Frequency: 400kHz; Number of Circuits: 1; Min Supply Voltage: 2.7V; Number of Taps: 256; Temperature Coefficient: 35ppm/°C; Memory Type: Volatile; Interface: I2C; -3db Bandwidth: 1.2MHz; Lead Free: Contains Lead; Contact Plating: Gold; Supply Current: 3uA; Mount: Surface Mount; RoHS Compliant: Yes; Packaging: Tape and Reel; REACH SVHC: No SVHC; Case/Package: SOT-23; Nominal Supply Current: 3uA; Number of Positions: 256; Min Operating Temperature: -40°C; Number of Elements: 1; Quiescent Current: 3uA; Package Quantity: 1; Operating Supply Voltage: 5.5V; Number of Pins: 8; Tolerance: 30%; Max Operating Temperature: 125°C; Operating Supply Current: 3uA; Series: -; Radiation Hardening: No; Taper: Linear
U37 = STM32U575ZI6T: QPF_144 without SMPS
U40 = ECMF02-2AMX6: No Description Available; Mfr_Name: STMicroelectronics; RefDes: RefDes; Type: Type
U41 = SC4216HSETRT: No Description Available; Mfr_Name: Semtech; RefDes: RefDes; Type: Type
U42 = TPS7A2030PDBVR: No Description Available; Mfr_Name: Texas Instruments; TYPE: TYPE; RefDes: RefDes
U43 U57 = TPS7A0225PDBVR: No Description Available; Mfr_Name: Texas Instruments; RefDes: RefDes; Type: Type
U44 = LM2660M: 100mA switched capacitor voltage converter; MP: LM2660MX/NOPB; MF: Texas Instruments; SnapEDA_Link: https://www.snapeda.com/parts/LM2660MX/NOPB/Texas+Instruments/view-part/?ref=snap; Check_prices: https://www.snapeda.com/parts/LM2660MX/NOPB/Texas+Instruments/view-part/?ref=eda; Price: None; Value: *; Purchase-URL: https://pricing.snapeda.com/search/part/LM2660MX/NOPB/?ref=eda; Availability: In Stock; Package: SOIC-8 Texas Instruments
U45 = TPS62143RGTR: 5V-Buck QFN; Mfr_Name: Texas Instruments; RefDes: RefDes; Type: Type
U46 = TPS72325DBVR: No Description Available; Mfr_Name: Texas Instruments; PartNumber: TPS72301DBV; CompType: IC; TYPE: TYPE; RefDes: RefDes; PackageReference: DBV0005A; MountType: SMT; RoHS: Y; Manufacturer: Texas Instruments
U47-U49 = OPA2320AIDR: Dual, Precision, Zero-Crossover, 20MHz, 0.9pA Ib, RRIO, CMOS Operational Amplifier 8-SOIC -40 to 125; MF: Texas Instruments; Value: *; Price: None; Purchase-URL: https://pricing.snapeda.com/search/part/OPA2320AIDR/?ref=eda; Package: SOIC-8 Texas Instruments; MP: OPA2320AIDR; Availability: Good; Check_prices: https://www.snapeda.com/parts/OPA2320AIDR/Texas%20Instruments/view-part/1237025/?ref=eda; SnapEDA_Link: https://www.snapeda.com/parts/OPA2320AIDR/Texas%20Instruments/view-part/1237025/?ref=snap
U50 = TLV75533PDBVR: 3.3V Regulator; Mfr_Name: Texas Instruments; TYPE: TYPE; RefDes: RefDes
U53 U54 = OPA320AIDBVR: Precision, zero-crossover, 20-MHz, 0.9-pA Ib, RRIO, CMOS operational amplifier; MF: Texas Instruments; Availability: In Stock; SnapEDA_Link: https://www.snapeda.com/parts/OPA320AIDBVR/Texas+Instruments/view-part/?ref=snap; Price: None; Check_prices: https://www.snapeda.com/parts/OPA320AIDBVR/Texas+Instruments/view-part/?ref=eda; Package: SOT-23-5 Texas Instruments; MP: OPA320AIDBVR; Value: *; Purchase-URL: https://pricing.snapeda.com/search/part/OPA320AIDBVR/?ref=eda
J16 J17 = M20-9990245: Package: None; Price: None; Value: *; MP: M20-9990245; Availability: Unavailable